# EAGLE design MCS (EAGLE 7.5.0) (continued)
## Board (continued)
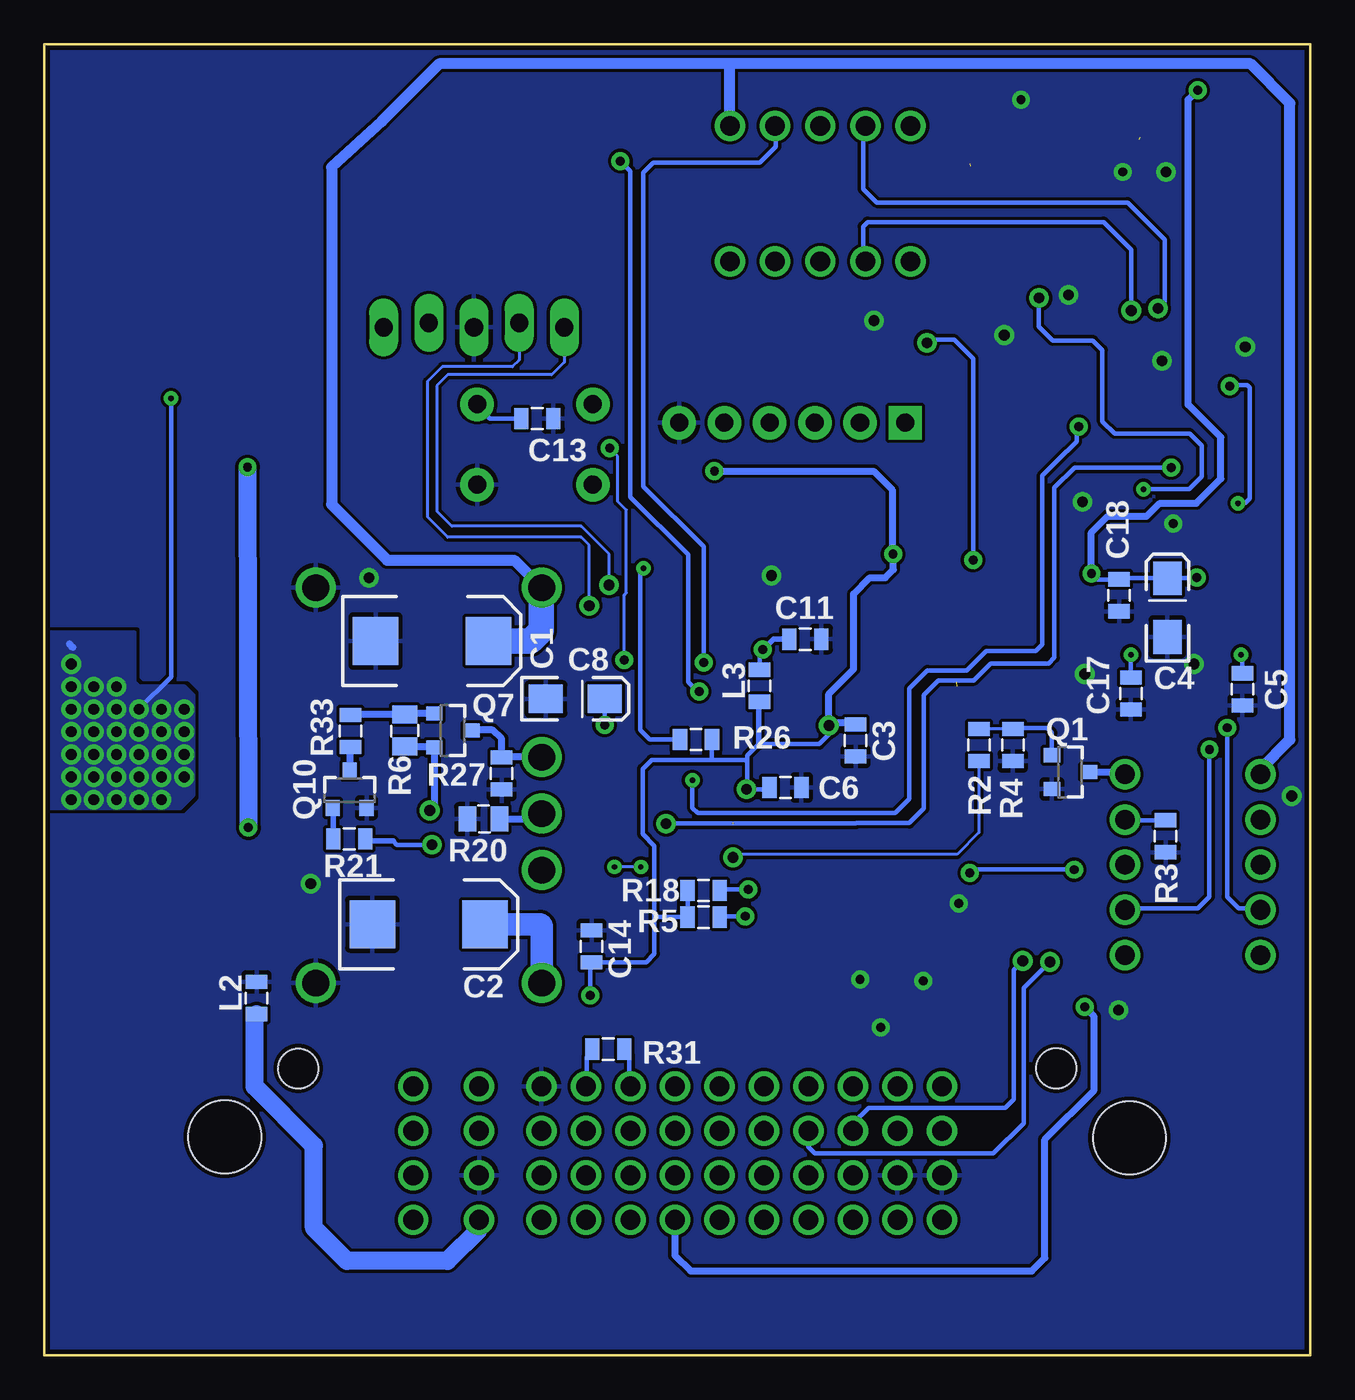
[diagram p3: board, bottom side, seen from below]

Size 71.12 x 73.66 mm. Coordinates in mm from the lower left corner, seen from the top.
Copper layers (1*16): Top 0.035mm / dielectric 1.5mm / Bottom 0.035mm
Design rules "SparkFun *": minimum track width 7mil, minimum drill 12mil, track to track 7mil, track to pad 7mil, pad to pad 7mil, via to via 7mil, smd to smd 7mil, copper to edge 10mil, drill to drill 8mil, minimum pad ring 12mil, minimum via ring 10mil, stop-mask expansion 4mil, vias tented up to drill 25mil, thermal gap 10mil

### Footprints (pad centres in the part's own frame; a part is rotated, then mirrored left to right if it is on the bottom)
CHIP_LED0805 = smd 1.2 x 1.2: A 0,-1.05; C 0,1.05
EIA7343 = smd 2.55 x 2.7: A 3.17,0; C -3.17,0
0805 = smd 0.8 x 1.2: 1 -0.9,0; 2 0.9,0
EIA3216-16V = smd 1.9 x 1.6: A 1.65,0; C -1.65,0
SMA = smd 1.27 x 1.47: A -2.15,0; C 2.15,0
SOD-123 = smd 1.4 x 1.4: A 1.9,0; C -1.9,0
1X05_LOCK_LONGPADS = drill 1.016 long: 1 0,0; 2 2.54,-0.254; 3 5.08,0; 4 7.62,-0.254; 5 10.16,0
36638-M = drill 1.1: 1 20.7,15.1; 2 20.7,12.6; 3 20.7,10.1; 4 20.7,7.6; 5 23.2,15.1; 6 23.2,12.6; 7 23.2,10.1; 8 23.2,7.6; 9 25.7,15.1; 10 25.7,12.6; 11 25.7,10.1; 12 25.7,7.6; 13 28.2,15.1; 14 28.2,12.6; 15 28.2,10.1; 16 28.2,7.6; 17 30.7,15.1; 18 30.7,12.6; 19 30.7,10.1; 20 30.7,7.6; 21 33.2,15.1; 22 33.2,12.6; 23 33.2,10.1; 24 33.2,7.6; 25 35.7,15.1; 26 35.7,12.6; 27 35.7,10.1; 28 35.7,7.6; 29 38.2,15.1; 30 38.2,12.6; 31 38.2,10.1; 32 38.2,7.6; 33 40.7,15.1; 34 40.7,12.6; 35 40.7,10.1; 36 40.7,7.6; 37 43.2,15.1; 38 43.2,12.6; 39 43.2,10.1; 40 43.2,7.6; 41 46.7,15.1; 42 46.7,12.6; 43 46.7,10.1; 44 46.7,7.6; 45 50.4,15.1; 46 50.4,12.6; 47 50.4,10.1; 48 50.4,7.6 | hole 2.25: 56.87,16.1; 14.28,16.12 | hole 4.1: 60.99,12.26; 10.16,12.21
FTDI_DEVICE_SIDE = drill 1.016 pad 1.88 square: P$1 -6.35,0 | drill 1.016 pad 1.88: P$2 -3.81,0; P$3 -1.27,0; P$4 1.27,0; P$5 3.81,0; P$6 6.35,0
TQ2-2M-24V = drill 1.1: 1 -5.08,-3.81; 2 -2.54,-3.81; 3 0,-3.81; 4 2.54,-3.81; 5 5.08,-3.81; 6 5.08,3.81; 7 2.54,3.81; 8 0,3.81; 9 -2.54,3.81; 10 -5.08,3.81
SOT23 = smd 0.8 x 0.9: 1 -0.95,-1; 2 0.95,-1; 3 0,1.1
SOT-363 = smd 0.42 x 0.6: 1 -0.65,-0.95; 2 0,-0.95; 3 0.65,-0.95; 4 0.65,0.95; 5 0,0.95; 6 -0.65,0.95
0805' = smd 1 x 1.4: 1 -0.9,0; 2 0.9,0
MNR14 = smd 0.5 x 0.75: 1 -1.25,-0.9; 4 1.25,-0.9; 5 1.25,0.85; 8 -1.25,0.85 | smd 0.4 x 0.75: 2 -0.4,-0.9; 3 0.4,-0.9; 6 0.4,0.85; 7 -0.4,0.85
TACTILE-PTH = drill 1.016 pad 1.88: 1 -3.251,2.261; 2 3.251,2.261; 3 -3.251,-2.261; 4 3.251,-2.261
SJ_2S-NO = smd 0.635 x 1.27: 1 -0.45,0; 2 0.45,0
0603 = smd 1.1 x 1: 1 -0.85,0; 2 0.85,0
TQFP-44 = smd 1.5 x 0.5: 1 -5.8,4; 2 -5.8,3.2; 3 -5.8,2.4; 4 -5.8,1.6; 5 -5.8,0.8; 6 -5.8,0; 7 -5.8,-0.8; 8 -5.8,-1.6; 9 -5.8,-2.4; 10 -5.8,-3.2; 11 -5.8,-4; 23 5.8,-4; 24 5.8,-3.2; 25 5.8,-2.4; 26 5.8,-1.6; 27 5.8,-0.8; 28 5.8,0; 29 5.8,0.8; 30 5.8,1.6; 31 5.8,2.4; 32 5.8,3.2; 33 5.8,4 | smd 0.5 x 1.5: 12 -4,-5.8; 13 -3.2,-5.8; 14 -2.4,-5.8; 15 -1.6,-5.8; 16 -0.8,-5.8; 17 0,-5.8; 18 0.8,-5.8; 19 1.6,-5.8; 20 2.4,-5.8; 21 3.2,-5.8; 22 4,-5.8; 34 4,5.8; 35 3.2,5.8; 36 2.4,5.8; 37 1.6,5.8; 38 0.8,5.8; 39 0,5.8; 40 -0.8,5.8; 41 -1.6,5.8; 42 -2.4,5.8; 43 -3.2,5.8; 44 -4,5.8
MSOP-8 = smd 0.3 x 1: 1 -0.975,-1.95; 2 -0.325,-1.95; 3 0.325,-1.95; 4 0.975,-1.95; 5 0.975,1.925; 6 0.325,1.925; 7 -0.325,1.925; 8 -0.975,1.925
SOT23-6 = smd 0.55 x 1.2: 1 -0.95,-1.3; 2 0,-1.3; 3 0.95,-1.3; 4 0.95,1.3; 5 0,1.3; 6 -0.95,1.3
PTN78060HAH = drill 1.5: 1 2.032,14.732; 2 2.032,2.032; 3 11.557,2.032; 4 14.732,2.032; 5 17.907,2.032; 6 24.257,2.032; 7 24.257,14.732
SOT23-5 = smd 0.55 x 1.2: 1 -0.95,-1.3; 2 0,-1.3; 3 0.95,-1.3; 4 0.95,1.3; 5 -0.95,1.3
DPAK = smd 1.6 x 3: 1 -2.28,-4.04; 3 2.28,-4.04 | smd 4.826 x 5.715: 2 0,2.858
SSOP-16 = smd 0.419 x 1.143: 1 -2.223,-2.642; 2 -1.587,-2.642; 3 -0.953,-2.642; 4 -0.318,-2.642; 5 0.318,-2.642; 6 0.953,-2.642; 7 1.587,-2.642; 8 2.223,-2.642; 9 2.223,2.642; 10 1.587,2.642; 11 0.953,2.642; 12 0.318,2.642; 13 -0.318,2.642; 14 -0.953,2.642; 15 -1.587,2.642; 16 -2.223,2.642
CRYSTAL-SMD-5X3 = smd 1.9 x 1.1: 1 -1.85,-1.15; 2 1.85,-1.15; 3 1.85,1.15; 4 -1.85,1.15

### Placement (x,y rotation side)
+3V  64.03,60.38 0 top
+5V  62,60.35 0 top
+9V  59.72,60.33 0 top
C1  49.35,40.13 0 bottom
C2  49.53,24.21 0 bottom
C3  25.55,34.54 270 bottom
C4  8.03,42.01 90 bottom
C5  3.81,37.41 270 bottom
C6  29.49,31.9 0 bottom
C7  66.85,27.2 180 top
C8  41.3,36.88 0 bottom
C9  25.17,47.55 90 top
C10  14.07,70.41 180 top
C11  28.37,40.23 0 bottom
C12  13.89,61.14 180 top
C13  43.43,52.63 0 bottom
C14  40.39,22.96 90 bottom
C15  9.32,70.26 0 top
C16  8.76,61.04 180 top
C17  10.08,37.19 270 bottom
C18  10.74,42.7 270 bottom
C19  65.58,39.5 0 top
C20  65.25,42.42 180 top
C21  20.75,37.82 0 top
C22  21.16,29.84 180 top
D1  59.94,26.01 90 top
D2  63.91,21.29 0 top
D5  21.29,41.58 90 top
J1  52.07,57.76 180 top
J3  0,0 0 top
JP1  29.11,52.4 0 top
K1  27.53,65.28 180 top
K2  6.6,27.56 270 top
L1  58.95,21.72 90 top
L2  59.21,20.07 90 bottom
L3  30.94,37.62 90 bottom
NTC  26.95,47.55 270 top
Q1  13.51,32.77 270 bottom
Q2  5.51,52.3 0 top
Q3  22.1,19.43 270 top
Q4  10.62,52.25 0 top
Q5  26.11,19.38 270 top
Q6  30.33,19.38 270 top
Q7  48.21,35.1 270 bottom
Q8  33.6,23.14 0 top
Q9  33.73,58.34 90 top
Q10  53.98,31.75 0 bottom
R1  3.76,37.57 180 top
R2  18.62,34.29 270 bottom
R3  8.13,29.16 90 bottom
R4  16.71,34.29 90 bottom
R5  34.09,24.61 180 bottom
R6  100k  [0805']  50.88,35.1 270 bottom
R7  9.98,37.64 180 top
R8  26.09,44.91 180 top
R9  10.64,49.89 180 top
R10  8.18,52.43 270 top
R11  2.87,52.45 270 top
R12  5.46,49.83 180 top
R13  33.81,55.83 0 top
R14  19.08,60.73 270 top
R15  17.12,60.76 270 top
R16  36.5,58.32 270 top
R17  1K  [0805']  29.54,23.85 270 top
R18  34.09,26.11 180 bottom
R19  62,56.62 270 top
R20  383k  [0805']  46.46,30.12 0 bottom
R21  54,29.01 0 bottom
R22  59.72,56.62 270 top
R23  64.03,56.62 270 top
R24  24.77,41.55 0 top
R25  36.5,42.21 90 top
R26  34.52,34.59 0 bottom
R27  45.44,32.69 90 bottom
R28  33.53,20.57 0 top
R29  27.53,23.8 90 top
R30  23.67,24.31 180 top
R31  39.45,17.2 180 bottom
R32  35.89,21.26 270 top
R33  53.92,35.08 90 bottom
RX1  35.2,27.43 270 top
RX2  17.2,68.07 0 top
S2  43.56,51.18 180 top
SJ1  35.05,44.48 0 top
TP1  7.9,19.81 0 top
TP2  60.4,41.61 180 top
TP3  65.61,69.95 90 top
TP4  7.59,42.9 90 top
TP5  1.47,42.9 90 top
TP6  2.54,19.76 0 top
TX1  35.18,25.76 270 top
TX2  19.1,68.02 0 top
U1  30.81,35.74 180 top
U2  38.58,22.02 180 top
U3  3.81,45.31 0 top
U4  10.01,45.39 0 top
U5  41.15,45.16 270 top
U6  3.81,40.67 180 top
U7  10.03,40.69 180 top
U8  63.93,34.14 270 top
U9  35.38,47.65 0 top
U10  63.86,47.88 270 top
U11  11.81,65.74 180 top
U$1  35.53,67.94 0 top
V1  63.53,23.62 0 top
Y1  20.98,33.73 270 top

### Tracks (layer width: path | path; a pad name or v marks a point on that pad's centre or on a via)
12V-EN  (via drill 0.6)
  Top 0.254: U1.12 34.81,41.92 35.1,42.22 37.67,42.22 38.2,42.75 38.2,43.89 38.89,44.58 40.74,44.58 41.63,43.69 41.63,39.62 42.22,39.04 47.37,39.04 47.93,38.48 47.93,29.13 48.39,28.68 v49.35,28.68
  Bottom 0.254: v49.35,28.68 51.33,28.68 51.54,28.88
  Bottom 0.305: 51.54,28.88 53.1,28.88 R21.2
+
  Top 0.406: L1.1 58.95,20.55
  Top 0.813: J3.48 55.02,7.6 57.05,9.63 57.05,13.01 58.95,14.91 58.95,20.55
+3V3  (via drill 0.3, 0.5, 0.6)  (2 unrouted)
  Top 0.178: R15.2 16.11,59.86 | C15.1 8.42,68.64 8.61,68.45 9.56,68.45
  Top 0.254: 26.8,35.69 v27.05,35.38 26.7,35.74 U1.28 | R15.2 19.05,59.86 R14.2 | 9.6,68.34 9.6,65.96 10.11,65.46 15.42,65.46 15.82,65.05 15.82,59.95 15.94,59.83 | 25.35,45.31 25.19,45.15 R8.2 25.08,45.01 v23.44,45.01 | U2.8 40.34,20.1 v40.46,20.22 | R9.2 9.74,51.17 Q4.1 9.67,48.88 | Q2.1 R12.2 4.47,49.74 4.47,48.84 4.67,48.64 9.42,48.64 9.67,48.88 | 9.67,48.88 9.59,48.88 v9.37,48.67 | U1.40 31.61,31.74 v31.67,31.8 | R23.2 64.03,53.8 v64.01,53.77
  Top 0.305: R14.2 15.94,59.83 15.47,59.41 v15.24,59.41
  Top 0.406: 62.97,36.6 v63.27,36.3 62.94,36.63 62.94,37.34 62.05,38.23 57.94,38.23 57.51,38.66 57.51,44.48 56.49,45.49 56.49,59.16 55.47,60.17 49.63,60.17 | R14.2 19.08,46.38 20.42,45.03 23.42,45.03 v23.44,45.01 | U9.5 34.43,49.49 | 34.43,49.49 34.24,49.68 v33.48,49.68 | 34.43,49.49 34.43,49.75 35.03,50.34 37.08,50.34 37.9,51.16 37.9,54.48 39.17,55.75 39.17,58.9 40.44,60.17 49.63,60.17 | J1.2 49.53,60.07 49.63,60.17
  Bottom 0.254: 25.61,35.38 C3.1 | C6.1 30.49,31.8 v31.67,31.8 31.62,31.85 31.62,33.33 | 31.62,33.33 31.62,33.71 30.99,34.34 27.58,34.34 27.05,34.87 v27.05,35.38 26.95,35.41 | 36.86,24.71 36.86,22.55 37.32,22.06 C14.1 40.46,21.98 v40.46,20.22 | 36.86,24.71 36.86,28.63 37.52,29.29 37.52,32.94 37.01,33.45 33.66,33.45 | 33.66,33.45 31.75,33.45 31.62,33.33 | R26.2 33.62,33.49 33.66,33.45 | 23.52,45.09 v23.44,45.01 | L3.1 30.94,36.59 30.99,36.54 | v9.37,48.67 6.81,48.67 6.1,49.38 6.1,51.1 6.78,51.79 11,51.79 11.68,52.48 11.68,56.49 12.22,57.02 14.48,57.02 15.27,57.81 15.27,59.38 v15.24,59.41 | R18.2 R5.2 36.75,24.61 36.86,24.71 | v64.01,53.77 64.01,38.1 v65.81,36.3
  Bottom 0.305: 25.46,35.53 C3.1 | 30.99,34.34 30.99,36.54
  Bottom 0.406: 69.72,39.98 69.52,39.78 | 15.21,59.38 v15.24,59.41 | v33.48,49.68 24.54,49.68 23.5,48.64 23.5,45.06 v23.44,45.01 23.42,44.98 23.42,44.15 23.88,43.69 24.74,43.69 25.65,42.77 25.65,38.56 27.05,37.16 v27.05,35.38 26.9,35.53 25.46,35.53
  other vias: 69.62,31.22 69.62,32.49 69.62,33.76 69.62,35.03 69.62,36.3 69.62,37.57 69.62,38.84 68.35,37.57 68.35,36.3 68.35,35.03 68.35,33.76 68.35,32.49 68.35,31.22 67.08,31.22 67.08,32.49 67.08,33.76 67.08,35.03 67.08,36.3 67.08,37.57 65.81,35.03 65.81,33.76 65.81,32.49 65.81,31.22 64.54,31.22 64.54,32.49 64.54,33.76 64.54,35.03 64.54,36.3 63.27,32.49 63.27,33.76 63.27,35.03
  pour Top (no thermals): 66.07,40.61 70.94,40.61 70.99,30.76 70.99,30.73 63.53,30.71 62.76,31.47 62.76,37.06 63.27,37.57 65.81,37.57 66.07,37.82
  pour Bottom: 69.67,30.73 63.53,30.71 62.76,31.47 62.76,37.06 63.27,37.57 65.81,37.57 66.07,37.82 66.07,40.61 70.94,40.64 71.04,30.73
+5V  (via drill 0.3, 0.5)
  Top 0.254: U4.3 11.61,44.09 11.94,43.76 | 11.94,43.76 11.94,39.83 11.53,39.42 11.01,39.42 U7.5 10.96,39.37 v10.08,39.37 | 5.82,43.59 5.82,43.69 5.49,44.01 U3.3 4.75,44.02 4.75,45.39 4.52,45.62 3,45.62 2.86,45.76 U3.6 R11.2 2.92,51.6 2.92,52.12 3.23,52.43 7.93,52.43 8.18,52.17 R10.2 | 5.82,43.59 5.82,39.67 5.54,39.4 4.79,39.4 U6.5 v3.89,39.37 | v6.38,43.69 5.92,43.69 5.82,43.59 | v12.29,43.92 12.17,43.79 11.96,43.79 11.94,43.76
  Top 0.305: R19.2 62,52.3 62.76,51.54 62.76,42.9 63.27,42.39 63.6,42.39
  Top 0.406: v6.32,71.09 6.32,72.34 6.55,72.57 53.26,72.57 57.28,68.56 57.28,47.12 57.84,46.56 58.86,46.56 U10.3
  Bottom 0.254: C5.1 3.81,39.29 v3.89,39.37 | C17.1 v10.08,39.37 | v6.38,43.69 6.4,43.66 C4.A 10.68,43.66 C18.1 11.97,43.6 v12.29,43.92
  Bottom 0.406: v12.29,43.92 12.29,46.23 11.38,47.14 9.2,47.14 8.46,47.88 6.4,47.88 5.03,49.25 5.03,51.59 6.86,53.42 6.86,70.56 v6.32,71.09
  pour Top (no thermals): 64.29,41.12 59.21,41.12 58.19,42.14 58.19,46.3 58.7,46.81 61.19,46.81 61.59,46.51 61.62,43.89 61.87,43.64 64.26,43.61 64.52,43.36 64.54,41.38
+9V  (via drill 0.5)
  Top 0.406: R22.2 59.72,51.03 59.97,50.77 | U10.1 59.82,50.06 v59.72,49.91
  Top 1.016: C7.A 63.47,27.2 63.27,27.41 | v59.66,29.64 59.61,29.64 59.39,29.87
  Bottom 1.016: v59.72,49.91 v59.66,29.64
  pour Top: 63.78,25.88 58.7,25.88 57.94,26.64 57.94,32.74 58.45,33.25 61.49,33.25 61.75,32.99 61.75,30.2 62,29.95 63.78,29.95 64.03,29.69 64.03,26.14
  pour Top (no thermals): 61.49,49 58.45,49 58.19,49.25 58.19,51.03 58.45,51.28 61.49,51.28 61.75,51.03 61.75,49.25
+12V
  Top 0.254: R32.2 36.08,20.36 37.11,21.39 42.7,21.39 U5.6
  Top 0.406: R28.2 34.43,20.54 34.65,20.32 35.85,20.32 R32.2
  Top 1.27: J3.45 50.4,16.66 49.25,17.8 43.74,17.8 43.26,18.29 43.26,20.83 U5.6 U5.5
  Bottom 1.27: C2.A 43.26,24.21 43.18,24.13 U5.6
+24V  (via drill 0.6)
  Top 0.406: v49.48,30.61 51.11,30.61 51.13,30.63
  Top 1.27: 44.27,41.99 50.11,41.99 51.13,40.97 51.13,30.63 51.13,19.1 52.91,17.32 52.91,10.85 52.22,10.16 50.46,10.16 J3.47
  Top 1.422: 44.27,41.99 44.27,42.04 U5.2
  Bottom 0.406: R6.2 49.26,34.2 Q7.2 49.21,30.88 v49.48,30.61
  Bottom 0.61: K2.1 2.79,32.94 1.14,34.59 1.14,70.36 3.35,72.57 32.51,72.57 | 32.51,72.57 48.95,72.57 52.15,69.37 52.15,69.34 54.99,66.75 54.99,47.8 51.87,44.68 44.73,44.68 U5.2 | K1.1 32.61,72.47 32.51,72.57
  Bottom 1.422: C1.A 43.79,40.13 43.21,40.72 43.21,43.1 U5.2
-
  Bottom 1.016: J3.44 46.7,7.07 48.49,5.28 54.13,5.28 55.98,7.14 55.98,11.76 59.31,15.09 59.31,19.06 L2.1
BOX_TEMP
  Top 0.254: 27,44.89 27,43.79 27.61,43.18 U1.21 | 26.99,46.61 R8.1
  Top 0.305: 27,44.89 R8.1 | 26.99,46.61 NTC.2 C9.1
BRAKE-OUT
  Top 0.254: Q5.3 25.16,15.64 J3.9
DAC-EN  (via drill 0.6)  (1 unrouted)
  Top 0.178: v32.44,27.96 32.44,29.86
  Bottom 0.178: R2.2 18.62,29.36 19.84,28.14 32.26,28.14 v32.44,27.96
FTDI-RX
  Top 0.254: JP1.P$3 27.81,52.38 27.81,51.49 29.59,49.71 29.59,46.63 29.97,46.25 31.57,46.25 33.21,44.62 U1.14
FTDI-TX
  Top 0.254: JP1.P$2 25.22,52.32 25.22,50.83 25.78,50.27 28.19,50.27 28.73,49.73 28.73,45.92 29.08,45.57 31.17,45.57 32.41,44.32 U1.15
FWD-EN
  Top 0.254: Q3.3 20.94,18.78 20.6,18.44 20.6,15.2 J3.1
GND  (via drill 0.5, 0.6)
  other vias: 10.77,19.38 1.04,31.42 56.16,26.49 19.76,25.37 52.88,43.69 25.3,21.11 24.13,18.41 21.74,21.03 10.54,66.5 30.28,43.81 16.26,70.56 7.7,46.74 12.67,38.28 6.53,38.84 12.8,47.96 3.66,56.67 8.33,55.88 17.2,57.33 13.59,59.59 8.1,66.5 24.51,58.14
  pour Top (rank 3): 71.09,0.03 0.15,-0.08 0.15,73.58 71.98,74.47
  pour Bottom (rank 3): 71.09,0.03 0.15,-0.08 0.15,73.58 72.16,73.53
IGN
  Top 0.254: J3.21 33.2,17.81 33.55,18.16 33.55,24.11 Q8.3
MC-1-B
  Top 0.254: J3.8 23.2,8.12 22.48,8.84 19.84,8.84 18.29,7.29 7.26,7.29 5.84,8.71 5.84,19.74 | 5.84,19.74 5.84,26.04 7.37,27.56 K2.8 10.74,27.56 | TP1.2 TP1.1 5.92,19.81 5.84,19.74
MC-1-T
  Top 0.254: 20.7,7.57 19.86,7.57 18.77,6.48 6.73,6.48 4.65,8.56 4.65,19.76 | 4.65,19.76 4.65,27 4.17,27.48 3.2,27.48 K2.3 | TP6.1 TP6.2 4.65,19.76
  Top 0.406: J3.4 20.7,7.57
MC-B
  Top 0.178: 27.64,28.85 27.61,28.83 27.61,27.08 27.08,26.54 25.48,26.54 24.92,25.99 R30.1
  Top 0.254: 27.64,28.85 27.64,29.91 U1.35
MC-F
  Top 0.178: 25.02,31.68 25.02,27.69 23.27,25.94 R30.3
  Top 0.254: 25.02,31.68 25.02,31.73 U1.33
MC-IGN
  Top 0.178: U1.36 28.41,26.66 27.53,25.78 R29.2
MC-PE
  Top 0.178: 26.85,28.88 26.87,28.85 26.87,27.41 26.57,27.1 25.22,27.1 24.07,25.95 R30.2
  Top 0.254: 26.85,28.88 26.85,29.9 U1.34
MC-PG-EN  (via drill 0.5, 0.6)
  Top 0.254: R13.1 21.54,55.83 | 21.54,55.83 20.14,54.43 20.14,50.39 20.93,49.61 27.64,49.61 28.25,49 28.25,44.17 29.24,43.18 29.24,41.56 U1.19 | v12.67,19.56 13.28,20.17 13.28,27.25 v13.26,27.28 | v19.13,27.1 19.1,27.1 18.69,27.51 18.69,44.42 v18.95,44.68 | v21.54,56.9 21.54,55.83
  Bottom 0.254: v13.26,27.28 18.95,27.28 v19.13,27.1 | v18.95,44.68 18.95,56.01 20.02,57.07 21.36,57.07 v21.54,56.9
  Bottom 0.406: J3.28 35.7,5.6 34.82,4.72 15.65,4.72 14.91,5.46 14.91,12.12 12.14,14.88 12.14,19.02 v12.67,19.56
MC-R
  Top 0.178: 24.93,32.56 23.9,32.56 23.65,32.31 23.65,27.15 22.42,25.93 R30.4
  Top 0.254: 24.93,32.56 24.99,32.56 U1.32
MC-RE
  Top 0.178: U1.37 29.21,26.29 29.52,25.98 29.52,24.78 R17.1
MCRX
  Top 0.254: K1.3 27.53,70.23 26.98,70.79 17.91,70.79 | 17.91,70.79 17.25,70.13 17.25,69.17 RX2.C | U11.4 12.13,71.01 12.6,71.48 17.22,71.48 17.91,70.79
MCTX
  Top 0.254: K1.8 27.53,65.61 26.21,66.93 21.08,66.93 20.37,67.64 20.37,68.66 19.99,69.04 19.14,69.04 TX2.C 19.1,68.28 18.87,68.05 15.85,68.05 14.61,66.8 11.68,66.8 11.49,66.99 U11.5
N$1  (via drill 0.3)
  Top 0.254: 46.3,53.57 44.5,53.57 44.25,53.31 44.25,47.37 43.79,46.91 37.69,46.91 37.47,46.69 v37.47,44.22 37.31,44.37 36.5,44.37 | 46.3,53.57 46.69,53.57 S2.3 46.91,53.54 51.21,53.54 52.07,54.41 J1.1 | 35.59,44.88 SJ1.2 35.55,44.42 36.45,44.42 36.5,44.37 | 46.38,53.49 46.3,53.57 | R25.2 36.5,44.37
  Bottom 0.254: C13.1 46.1,52.63 S2.3 | R26.1 37.11,34.59 37.64,35.13 37.64,44.04 v37.47,44.22
N$2  (via drill 0.5)
  Top 0.254: U1.17 30.81,41.49 30.76,41.36
  Top 0.305: v30.76,39.65 30.76,41.36
  Bottom 0.254: L3.2 30.94,39.47 v30.76,39.65
  Bottom 0.305: 30.94,39.5 v30.76,39.65 30.15,40.23 C11.1
N$3  (via drill 0.5)
  Top 0.254: U7.1 10.98,40.8 10.72,40.51 9.25,40.51 9.07,40.34 9.07,39.41 | 9.07,39.41 U7.4 | 9.07,39.41 9.07,37.66 R7.2 6.66,37.64 6.07,37.06 6.07,34.42 v5.66,34.04
  Bottom 0.254: v5.66,34.04 5.66,25.76 6.32,25.09 10.34,25.09 K2.7
N$4  (via drill 0.5)
  Top 0.254: U1.7 38.8,36.54 v39.65,35.41
  Bottom 0.254: v39.65,35.41 39.65,36.27 C8.A
N$5
  Top 0.254: 25.58,41.49 26.76,41.49 U1.22
  Top 0.305: 25.58,41.49 R24.2
N$6
  Top 0.305: +9V.A R22.1
N$7
  Top 0.254: R30.6 23.27,21.61 23.8,21.08 23.8,19.61 23.62,19.43 Q3.5
N$8
  Top 0.178: R25.1 36.41,41.31 35.18,40.08 31.98,40.08 31.67,39.78 31.67,39.17 31.22,38.71 30.1,38.71 29.79,39.01 29.79,40.13 30.05,40.39 30.05,41.45
  Top 0.254: U1.18 30.01,41.49 30.05,41.45
N$9  (via drill 0.5)
  Top 0.254: TX1.A 32.84,25.76 v31.75,24.66
  Bottom 0.254: v31.75,24.66 33.14,24.66 R5.1
N$10
  Top 0.254: U9.1 34.43,44.65 SJ1.1
N$11  (via drill 0.5)
  Top 0.254: RX1.A 33.66,27.43 32.77,26.54 31.95,26.54 v31.57,26.16
  Bottom 0.254: v31.57,26.16 33.14,26.16 R18.1
N$12  (via drill 0.6)
  Top 0.178: v40.51,42.11 40.18,41.78 40.16,37.85 39.65,37.34 U1.8
  Bottom 0.178: v40.51,42.11 40.51,45.52 40.97,45.97 48.46,45.97 49.61,47.12 49.61,54.71 48.77,55.55 44.83,55.55 44.45,55.93 J1.4
N$13
  Top 0.305: +3V.A R23.1
N$14
  Bottom 0.406: Q7.1 50.83,36.05 R6.1 53.92,36 R33.2
N$15  (via drill 0.6)
  Top 0.178: v39.4,43.28 39.4,38.41 39.13,38.14 U1.9
  Bottom 0.178: v39.4,43.28 39.4,45.01 40.97,46.58 48.23,46.58 49.07,47.42 49.07,54.48 48.46,55.09 42.62,55.09 41.91,55.8 J1.5
N$16
  Top 0.178: Q6.6 32.08,20.03 R28.1 32.63,22.11 Q8.1
N$17
  Top 0.254: TP5.2 TP5.1 2.78,42.05 U6.3
  Top 0.305: U3.1 U6.3
N$18  (via drill 0.5)
  Top 0.254: U6.1 4.76,40.95 4.47,40.66 3.12,40.66 2.87,40.41 2.87,39.38 | 2.87,39.38 U6.4 | 2.87,39.38 2.87,37.58 R1.2 2.86,35.85 3.12,35.59 4.34,35.59 v4.67,35.26
  Bottom 0.254: v4.67,35.26 4.67,25.76 4.01,25.09 2.87,25.09 K2.4
N$19
  Top 0.254: Q6.2 29.97,19.38 30.07,19.48 30.07,21.01 29.31,21.77 27.84,21.77 27.53,22.07 R29.1
N$20
  Top 0.254: R30.5 22.42,22.17 22.23,21.97 20.73,21.97 20.04,21.29 20.04,19.63 20.27,19.41 21.12,19.41 Q3.2
N$21
  Top 0.254: K2.9 K2.2
  Bottom 0.254: R3.2 10.37,30.06 K2.9
N$22
  Top 0.254: TP4.2 TP4.1 9.02,42.05 U7.3
  Top 0.305: U4.1 9.06,42.02 U7.3
N$23
  Bottom 0.406: U5.3 45.43,33.6 R27.2 45.44,34.65 45.92,35.13 47.08,35.13 Q7.3
N$24
  Top 0.254: D5.A 23.33,41.58 R24.1
N$25
  Bottom 0.406: Q1.3 10.54,32.77 K2.10
N$26
  Top 0.406: Q9.3 32.63,61.45 K1.10
N$27
  Bottom 0.305: Q10.1 54.9,30.75 R21.1
N$28
  Top 0.406: Q8.2 35.87,22.14 R32.1
N$29
  Top 0.254: R30.8 24.92,22.47 25.3,22.1 25.86,22.1 26.31,21.64 26.31,19.48 26.42,19.38 Q5.5
N$30
  Bottom 0.406: R33.1 53.98,34.18 Q10.3
N$35
  Top 0.254: Q6.5 30.84,19.38 30.63,19.58 30.63,21.21 29.57,22.28 29.57,22.93 R17.2
N$39
  Top 0.254: U1.31 22.39,33.34 22.34,33.29 | 22.06,31.81 C22.1
  Top 0.305: 22.34,33.29 22.02,32.97 22.02,31.99 Y1.3 22.06,31.81
N$40  (1 unrouted)
  Top 0.254: U1.30 20.45,34.14 20.4,34.09
  Top 0.305: 20.4,34.09 19.89,34.59 19.89,35.52 Y1.1 19.83,37.57
N$41
  Top 0.305: +5V.A R19.1
N$42
  Bottom 0.178: R4.2 R2.1
  Bottom 0.254: 16.69,35.16 R4.2 16.65,35.26 14.78,35.26 14.51,34.98 Q1.1
N$59
  Top 0.254: C10.1 15.21,70.37 15.19,69.52 14.48,68.81 U11.1
N$63
  pour Top (no thermals): 63.02,20.04 60.48,20.04 60.22,20.29 60.22,21.82 59.72,22.33 58.45,22.33 58.19,22.58 58.19,24.36 58.45,24.61 63.02,24.61 63.27,24.36 63.27,20.29
N$65
  Top 0.254: 13.45,70.41 C10.2 13.4,69.8 U11.2
N$66
  Top 0.254: C12.1 14.88,61.23 14.88,62.76 14.55,63.09 U11.16
N$67
  Top 0.254: C12.2 13.45,61.59 13.4,61.64 U11.15
N$68
  Top 0.254: C15.2 10.27,70.2 10.27,68.43 U11.7
N$72
  Top 0.254: C16.1 9.66,61.17 10.24,61.75 10.24,63.06 10.22,63.07 U11.10
N$73
  Top 0.254: J3.2 20.68,12.62 18.19,12.62 17.35,13.46 17.35,52.83 11.3,58.88 11.3,62.26 11.49,62.45 U11.12
N$74
  Top 0.254: J3.6 21.96,13.84 19.43,13.84 18.03,15.24 18.03,53.21 12.57,58.67 11.94,59.23 11.94,61.98 12.13,62.24 U11.13
N$75
  Top 0.254: RX2.A 17.2,61.73 R15.1
N$76  (1 unrouted)
  Top 0.254: R14.1 19.08,66.82
N$78
  Top 0.406: R13.2 34.71,57.37 Q9.1 34.76,57.42 R16.2
N$79
  Bottom 0.406: R20.2 43.49,30.12 U5.4
N$81
  Top 0.254: R30.7 24.07,21.77 24.36,21.49 24.36,19.61 24.59,19.38 Q5.2
OUT-RX  (via drill 0.6)
  Top 0.254: v14.63,22.1 14.63,52.53 8.56,58.6 v8.56,58.83
  Bottom 0.254: J3.14 28.2,11.69 27.84,11.33 17.81,11.33 16.1,13.03 16.1,20.62 v14.63,22.1 | v8.56,58.83 8.18,59.21 8.18,62.69 10.26,64.77 24.36,64.77 25.12,65.53 25.12,68.96 K1.4
OUT-TX  (via drill 0.6)
  Top 0.254: v16.15,22.15 16.15,52.6 v10.06,58.7
  Bottom 0.254: J3.10 25.7,13.01 24.82,13.89 17.15,13.89 16.66,14.38 16.66,21.64 v16.15,22.15 | v10.06,58.7 10.06,62.13 11.61,63.68 24.87,63.68 25.12,63.42 25.12,61.59 K1.7
PROGRAM-EN
  Top 0.254: Q5.6 27.72,20.03 27.99,19.76 27.99,15.31 J3.13
REGEN-DISABLE
  Top 0.254: Q6.3 29.38,17.99 30.73,16.64 30.73,15.13 J3.17
REV-EN
  Top 0.254: Q3.6 22.57,20.08 22.2,19.71 22.2,16.1 J3.5
RS-A
  Top 0.254: U2.6 38.26,15.16 J3.29
  Bottom 0.254: R31.1 38.55,17.18 38.28,16.92 38.28,15.18 J3.29
RS-B
  Top 0.254: U2.7 38.91,19.39 40.49,17.8 40.49,15.31 J3.33
  Bottom 0.254: R31.2 40.35,17.06 40.64,16.76 40.64,15.16 J3.33
RX2  (via drill 0.5)
  Top 0.254: U1.42 33.21,38.04 v34.09,38.91
  Bottom 0.254: v34.09,38.91 34.09,45.44 37.47,48.82 37.47,66.45 36.91,67 30.94,67 30.02,67.92 30.02,69.04 K1.2
RXD1  (via drill 0.3)
  Top 0.178: U2.1 39.56,27.46 | 39.56,27.46 39.56,32.07 38.28,33.35 36.62,33.35 U1.3 | RX1.C v37.62,27.43 | v39.09,27.43 39.53,27.43 39.56,27.46
  Bottom 0.178: v37.62,27.43 v39.09,27.43
SCL  (via drill 0.5, 0.6)
  Top 0.254: 36.18,29.89 v36.2,29.87 36.13,29.94 U1.44 | Q2.2 6.36,51.2 R12.1 6.41,49.89 v7.82,49.89
  Bottom 0.254: v36.2,29.87 25.53,29.87 25.5,29.9 22.53,29.9 21.72,30.71 21.72,37.11 20.9,37.92 18.9,37.92 17.96,38.86 14.71,38.86 14.38,39.19 14.38,48.74 13.23,49.89 v7.82,49.89 7.54,49.89
SCL_5V  (via drill 0.3, 0.5)
  Top 0.254: R11.1 4.5,53.35 | 4.5,53.35 5.46,53.35 Q2.3 | U3.5 3.81,47.62 v4.06,47.88 8.97,47.88 9.98,47.35 9.98,46.72 U4.5 | v4.52,54.46 4.52,53.38 4.5,53.35
  Bottom 0.254: v4.06,47.88 3.66,47.88 3.4,48.13 3.4,54.38 3.53,54.51 4.47,54.51 v4.52,54.46
SDA  (via drill 0.3, 0.5)
  Top 0.254: v34.72,32.31 34.72,32.11 35.12,31.74 U1.1 | v13.01,52.17 11.89,52.17 11.58,51.87 11.58,51.26 Q4.2 11.57,49.91 R9.1
  Bottom 0.254: v34.72,32.31 34.72,30.73 34.42,30.48 23.32,30.48 22.53,31.27 22.53,37.47 21.51,38.48 19.3,38.48 18.21,39.57 15.42,39.57 15.06,39.93 15.06,49.43 13.69,50.8 13.67,50.8 13.13,51.33 13.13,52.05 v13.01,52.17
SDA_5V
  Top 0.254: R10.1 8.2,53.35 Q4.3 10.67,53.3 10.67,48.72 10.96,48.43 U4.4 10.9,46.63 10.9,45.59 10.72,45.41 5.97,45.41 5.79,45.59 5.79,46.08 5.25,46.61 U3.4
TX2  (via drill 0.5)
  Top 0.254: U1.43 34.01,31.27 33.71,31.57 33.71,36.65 v34.34,37.29 | v38.76,67.11 31.04,67.11 30.07,66.14 K1.9
  Bottom 0.254: v34.34,37.29 34.42,37.29 34.95,37.82 34.95,44.98 38.2,48.23 38.2,66.55 v38.76,67.11
TXD1
  Top 0.178: U2.4 37.61,25.19 | U1.2 37.8,32.54 38.35,32 38.35,25.91 37.61,25.19 | TX1.C 37.04,25.76 37.61,25.19
U5-RE/DE
  Top 0.178: U2.2 U2.3 U2.2 | U2.2 38.94,24 38.94,23.09 39.07,22.96 39.95,22.96 40.18,23.19 40.18,32.18 38.23,34.14 U1.4 | U1.4
WDI  (via drill 0.5)
  Top 0.178: U1.10 38.43,38.94 v38.56,39.06 | v39.37,50.98 39.34,50.98 38.51,50.14 38.51,49.17 38.23,48.9 36.39,48.9 U9.4
  Bottom 0.178: v38.56,39.06 38.56,42.72 38.43,42.85 38.43,47.5 38.91,47.98 38.91,50.52 v39.37,50.98

### Text on the board
Top: RJ